# EasyEDA Pro project YanQi_Project.eprj, board PayloadBoard (continued)
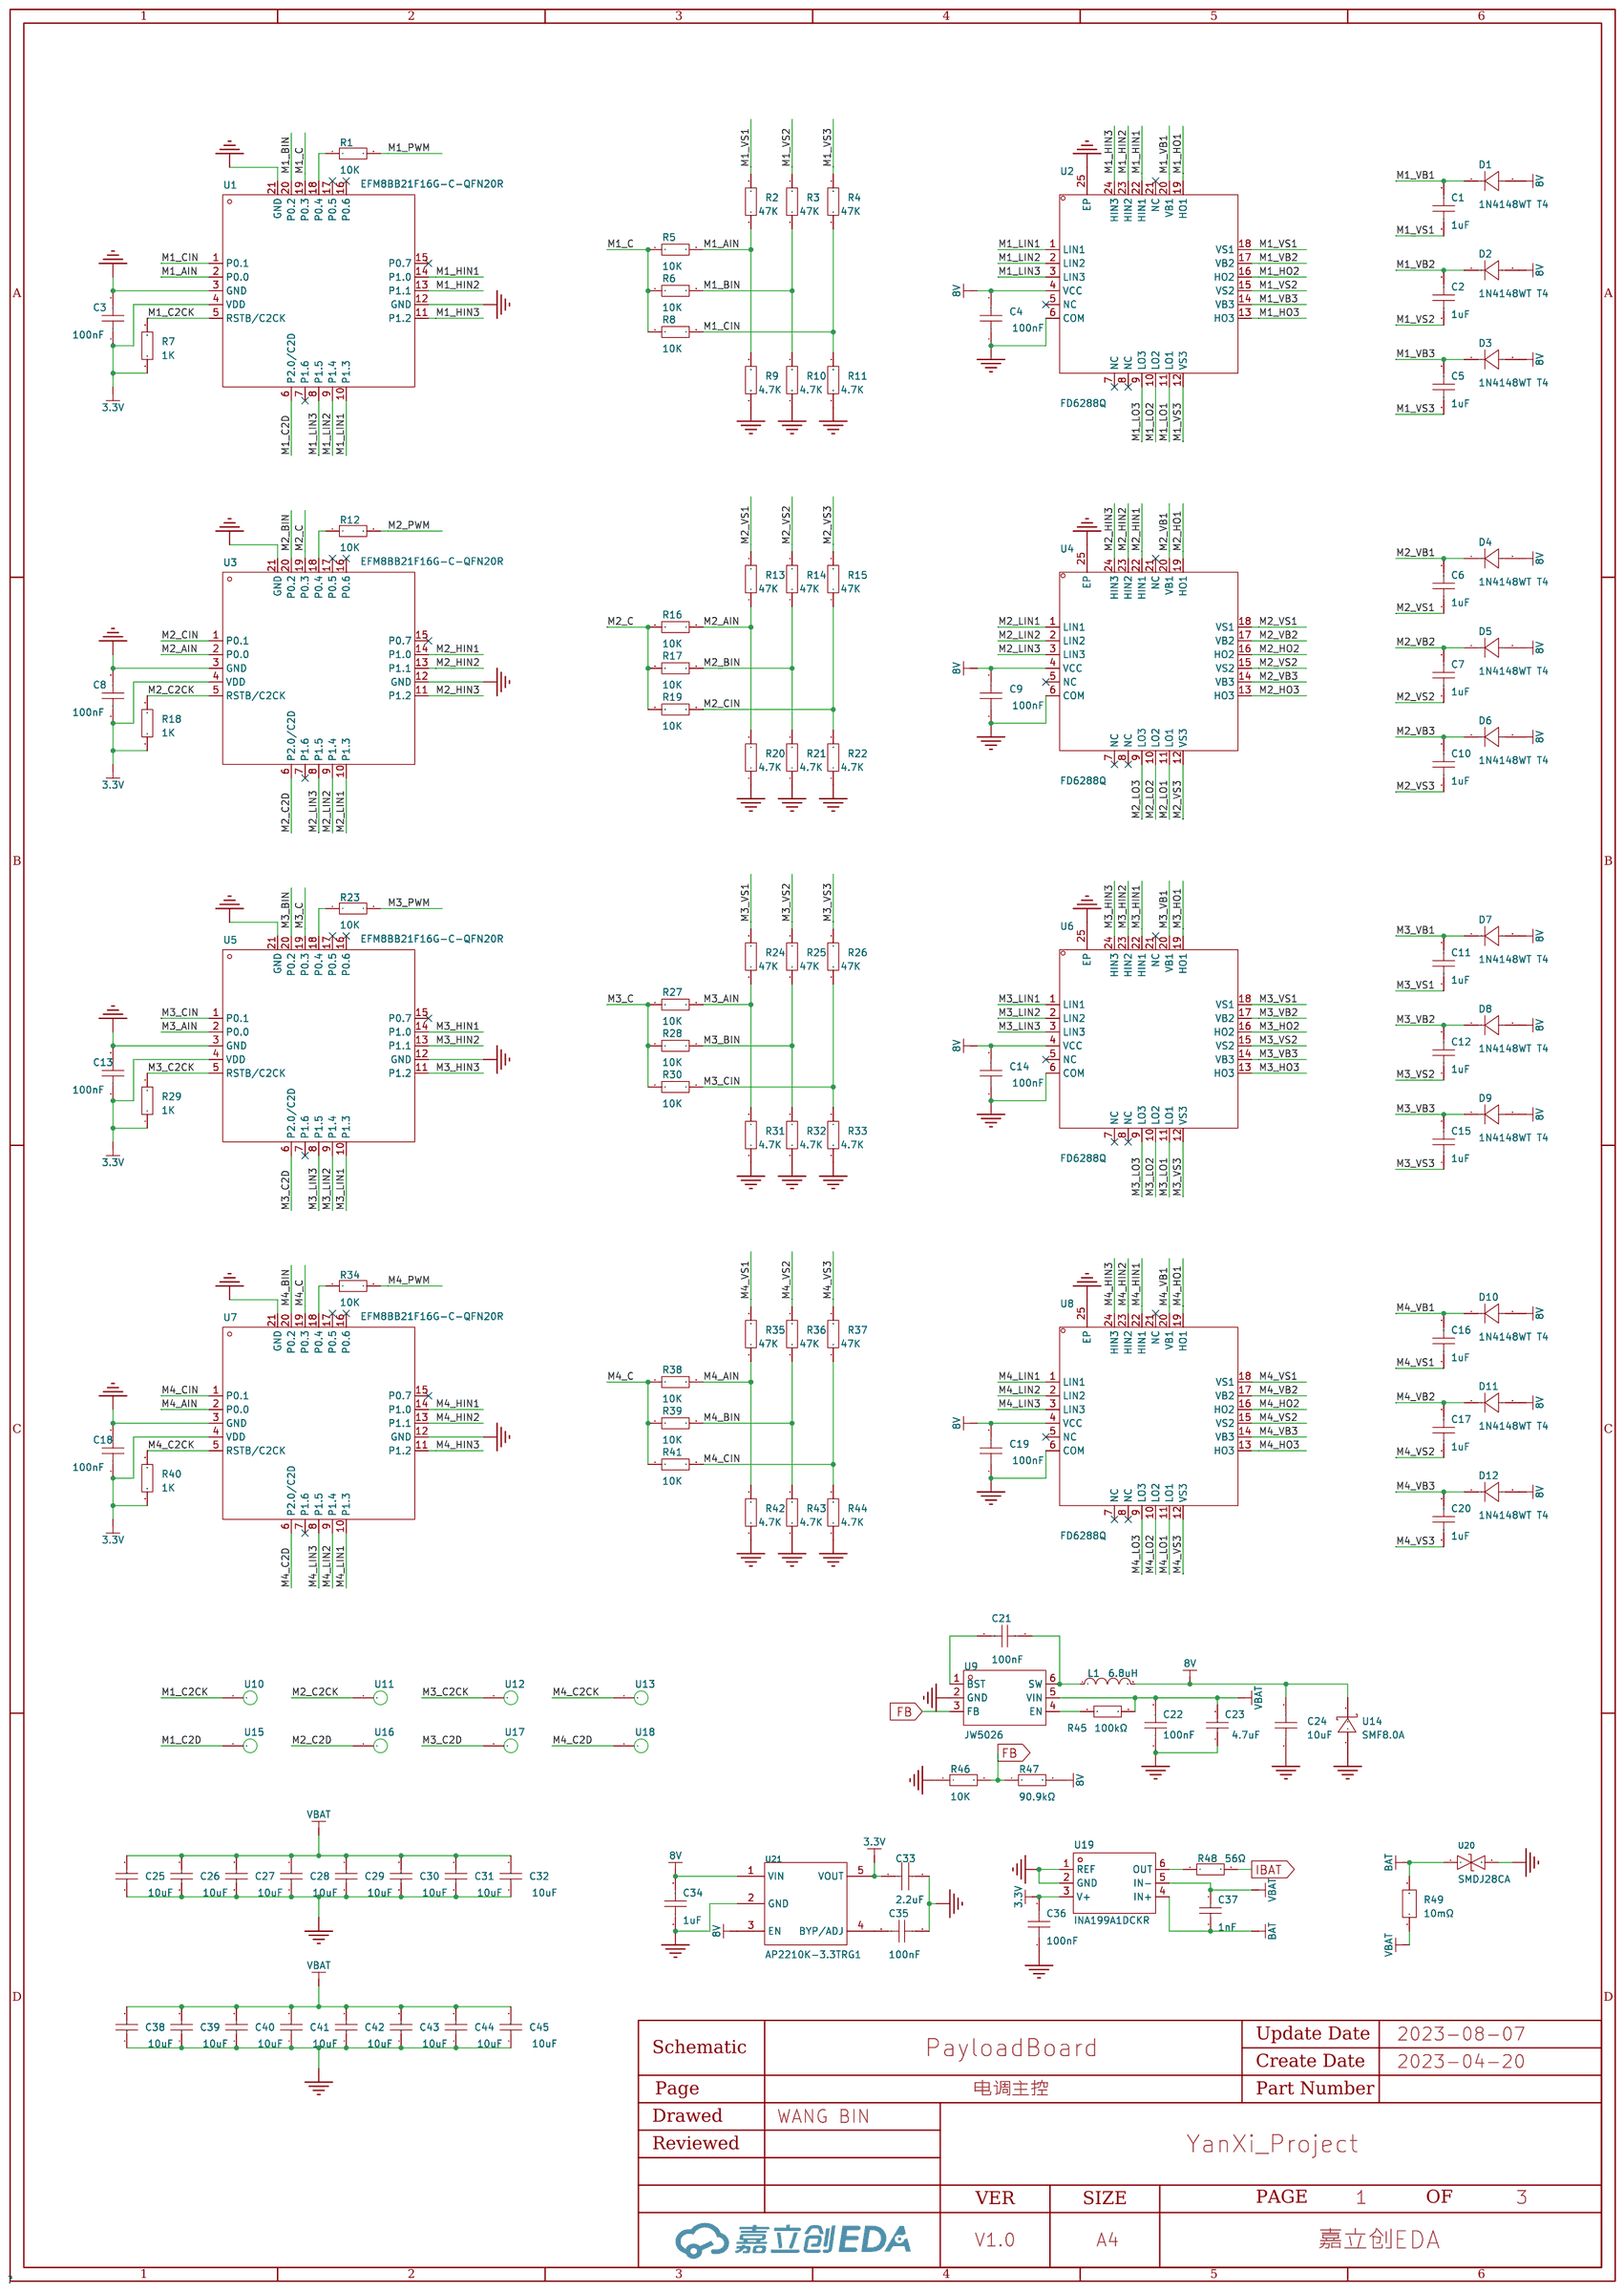
[diagram p0: 电调主控]
## Routing (per net, layer and track width the routed paths; a pad name or vN(x,y) marks a point on that pad's centre or on a via; arc(x,y) is an arc through that point) (continued)
GND:
  vias: v1(0.53,59) v1(1.03,59) v1(4.61,63) v1(4.8,75) v1(4.8,74.5) v1(4.8,74) v1(4.8,73.5) v1(4.8,73) v1(4.75,55.37) v1(4.75,54.87) v1(4.75,54.37) v1(4.8,45) v1(4.8,44.5) v1(4.8,44) v1(4.8,43.5) v1(4.8,43) v1(5.11,63.5) v1(5.11,63) v1(5.11,62.5) v1(5.3,75) v1(5.3,74.5) v1(5.3,74) v1(5.3,73.5) v1(5.3,73) v1(5.25,55.37) v1(5.25,54.87) v1(5.25,54.37) v1(5.3,45) v1(5.3,44.5) v1(5.3,44) v1(5.3,43.5) v1(5.3,43) v1(5.61,63) v1(6.7,76.3) v1(6.7,75.8) v1(6.7,42.2) v1(6.7,41.7) v1(6.84,66.3) v1(7.2,76.3) v1(7.2,75.8) v1(7.2,42.2) v1(7.2,41.7) v1(7.7,76.3) v1(7.7,75.8) v1(7.7,42.2) v1(7.7,41.7) v1(8.2,76.3) v1(8.2,75.8) v1(8.2,42.2) v1(8.2,41.7) v1(8.7,76.3) v1(8.7,75.8) v1(8.7,42.2) v1(8.7,41.7) v1(8.88,51.7) v1(10.12,55) v1(10.48,62.63) v1(10.62,55.5) v1(10.62,55) v1(10.62,54.5) v1(10.7,76.3) v1(10.7,75.8) v1(10.7,42.2) v1(10.7,41.7) v1(10.98,62.63) v1(11.12,55) v1(11.2,76.3) v1(11.2,75.8) v1(11.2,42.2) v1(11.2,41.7) v1(11.7,76.3) v1(11.7,75.8) v1(11.7,42.2) v1(11.7,41.7) v1(12.2,76.3) v1(12.2,75.8) v1(12.2,42.2) v1(12.2,41.7) v1(12.7,76.3) v1(12.7,75.8) v1(12.7,42.2) v1(12.7,41.7) v1(12.9,35.2) v1(12.9,34.7) v1(13.1,83.1) v1(13.1,82.6) v1(13.4,35.2) v1(13.4,34.7) v1(13.6,83.1) v1(13.6,82.6) v1(14.6,59.1) v1(15.2,35.4) v1(18.2,35.41) v1(24.2,35.41) v1(27.2,35.41) v1(30.2,35.41) v1(33.2,35.41) v1(36.2,35.4) v1(36.6,88.8) v1(40.7,43.6) v1(40.7,43.1) v1(41.2,43.6) v1(41.2,43.1) v1(47.8,88.8) v1(62.2,35.41) v1(62.7,42.4) v1(62.7,41.9) v1(63.2,42.4) v1(63.2,41.9) v1(64.4,78.4) v1(64.4,77.9) v1(64.9,78.4) v1(64.9,77.9) v1(65.2,35.4) v1(65.4,78.4) v1(65.4,77.9) v1(65.9,78.4) v1(65.9,77.9) v1(66.4,78.4) v1(66.4,77.9) v1(66.9,78.4) v1(66.9,77.9) v1(67.4,78.4) v1(67.4,77.9) v1(67.9,78.4) v1(67.9,77.9) v1(68.2,35.41) v1(68.4,78.4) v1(68.4,77.9) v1(68.9,78.4) v1(68.9,77.9) v1(71.2,35.4) v1(72.9,81.64) v1(74.2,35.41) v1(77.2,35.41) v1(80.2,35.4) v1(83.2,35.4) v1(83.79,62.87) v1(83.79,58.9) v1(84.8,83.2) v1(84.8,82.7) v1(84.8,35.4) v1(84.8,34.9) v1(85.3,83.2) v1(85.3,82.7) v1(85.3,35.4) v1(85.3,34.9) v1(85.7,76.3) v1(85.7,75.8) v1(85.7,42.2) v1(85.7,41.7) v1(86.2,76.3) v1(86.2,75.8) v1(86.2,42.2) v1(86.2,41.7) v1(86.7,76.3) v1(86.7,75.8) v1(86.7,42.2) v1(86.7,41.7) v1(87.2,76.3) v1(87.2,75.8) v1(87.2,42.2) v1(87.2,41.7) v1(87.28,63) v1(87.42,55.37) v1(87.42,54.87) v1(87.42,54.37) v1(87.7,76.3) v1(87.7,75.8) v1(87.7,42.2) v1(87.7,41.7) v1(87.78,63.5) v1(87.78,63) v1(87.78,62.5) v1(87.92,55.37) v1(87.92,54.87) v1(88.28,63) v1(89.52,66.3) v1(89.7,76.3) v1(89.7,75.8) v1(89.7,42.2) v1(89.7,41.7) v1(90.2,76.3) v1(90.2,75.8) v1(90.2,42.2) v1(90.2,41.7) v1(90.7,76.3) v1(90.7,75.8) v1(90.7,42.2) v1(90.7,41.7) v1(91.2,76.3) v1(91.2,75.8) v1(91.2,42.2) v1(91.2,41.7) v1(91.55,51.7) v1(91.7,76.3) v1(91.7,75.8) v1(91.7,42.2) v1(91.7,41.7) v1(92.79,55) v1(93.1,75) v1(93.1,74.5) v1(93.1,74) v1(93.1,73.5) v1(93.1,73) v1(93.15,63.13) v1(93.15,62.63) v1(93.1,45) v1(93.1,44.5) v1(93.1,44) v1(93.1,43.5) v1(93.1,43) v1(93.29,55.5) v1(93.29,55) v1(93.29,54.5) v1(93.6,75) v1(93.6,74.5) v1(93.6,74) v1(93.6,73.5) v1(93.6,73) v1(93.65,63.13) v1(93.65,62.63) v1(93.6,45) v1(93.6,44.5) v1(93.6,44) v1(93.6,43.5) v1(93.6,43) v1(93.79,55) v1(97.3,59.01) v1(97.8,59.01)
VBAT: length 237.9
  Top Layer w0.254: U19.5 31.5,81.5 30.9,80.9 C37.2 30.74,78.6 30.24,78.1 17.9,78.1 R49.1
  Top Layer w0.5: 75.7,81.44 75.55,81.44 74.9,80.8 U9.5 73.4,80.8 72.9,80.3 72.9,78.7 C23.2 72.43,77.77 v1(73.8,77.77) ; 17.5,50.6 17.5,53.5 U28.1
  Top Layer w2: v1(82.2,69.7) 82.2,38.59 ; 82.2,38.59 C44.2 C43.2 C42.2 C41.2 C40.2 C39.2 C38.2 62.19,38.6 60.9,38.6 58.9,36.6 58.9,32.6 56,29.7 42.4,29.7 39.5,32.6 39.5,36.59 37.5,38.59 C32.2 C31.2 C30.2 C29.2 C28.2 C27.2 C26.2 16.2,38.59 ; 82.2,38.59 C45.2 ; 16.2,38.59 C25.2 ; 16.2,38.59 16.2,50.2 19,50.2 v1(19.2,50.4) v1(19.2,50.9) v1(19.2,51.4) ; 16.2,77.9 16.2,67.8 19,67.8 v1(19.2,67.6) v1(19.2,67.1) v1(19.2,66.6)
  Inner1 w0.5: v1(73.8,77.77) 81.73,77.77 82.2,77.3 v1(82.2,69.7)
  Inner1 w2: v1(19.2,67.6) v1(19.2,67.1) v1(19.2,66.6) v1(19.2,66.1) v1(19.2,51.9) v1(19.2,51.4) v1(19.2,50.9) v1(19.2,50.4)
  Inner2 w2: v1(19.2,67.6) v1(19.2,67.1) v1(19.2,66.6) v1(19.2,66.1) v1(19.2,51.9) v1(19.2,51.4) v1(19.2,50.9) v1(19.2,50.4)
  Bottom Layer w2: v1(19.2,50.4) v1(19.2,50.9) v1(19.2,51.4) v1(19.2,51.9) v1(19.2,66.1) v1(19.2,66.6) v1(19.2,67.1) v1(19.2,67.6)
  vias: v1(18.7,68.1) v1(18.7,67.6) v1(18.7,67.1) v1(18.7,66.6) v1(18.7,66.1) v1(18.7,51.9) v1(18.7,51.4) v1(18.7,50.9) v1(18.7,50.4) v1(18.7,49.9) v1(19.2,68.1) v1(19.2,49.9) v1(19.7,68.1) v1(19.7,67.6) v1(19.7,67.1) v1(19.7,66.6) v1(19.7,66.1) v1(19.7,51.9) v1(19.7,51.4) v1(19.7,50.9) v1(19.7,50.4) v1(19.7,49.9)
BAT: length 1.3
  Top Layer w0.254: C37.1 30.91,82.15 U19.4
  vias: v1(21.82,81.53) v1(21.82,81.03) v1(22.32,81.53) v1(22.32,81.03) v1(22.82,81.53) v1(22.82,81.03) v1(23.32,81.53) v1(23.32,81.03) v1(23.82,81.53) v1(23.82,81.03)
BUZ-: length 43.7
  Top Layer w0.254: v1(60.2,88.6) 59,89.8 52,89.8 51.3,90.5 47.1,90.5 46.4,89.8 40.4,89.8 39.7,90.5 U26.3
  Inner2 w0.254: v1(60.2,88.6) 63.62,88.6 65.4,86.82 65.4,83.8 65.9,83.3 70.9,83.3 71.38,82.82 v1(71.38,82.58)
  Bottom Layer w0.254: BUZZER1.2 71.38,78.98 v1(71.38,82.58)
FB: length 2.7
  Top Layer w0.5: U9.3 71.53,79.83 70.87,79.83 70.37,80.33 70.1,80.33 70.1,81.37
IBAT: length 37
  Inner1 w0.254: v1(16.5,57.5) 17,58 17,64 15.47,65.53 15.47,76.07 17.4,78 31.83,78 v1(32.1,78.27)
M1_AIN: length 5
  Top Layer w0.254: R9.2 R5.2 ; R5.2 84.69,60.8 86.8,60.8 87.03,61.02 U1.2 ; R5.2 R2.1
M1_BIN: length 9.4
  Top Layer w0.254: v1(87.61,66.3) v1(86.57,66.3) ; v1(85.75,62.17) 85.83,62.25 U1.20
  Inner1 w0.254: v1(90.38,66.3) 90.38,66.08 90.1,65.8 88.27,65.8 87.76,66.3 v1(87.61,66.3) ; v1(85.75,62.17) 86.57,63 v1(86.57,66.3)
M1_C: length 13.2
  Top Layer w0.254: U1.19 85.47,62.75 v1(85.45,62.77)
  Inner1 w0.254: v1(83.79,60.84) 83.28,61.35 83.28,63.38 v1(83.79,63.89) 84.91,62.77 v1(85.45,62.77) 85.45,65.95 86.31,66.81 87.97,66.81 v1(88.48,66.3)
M1_C2CK: length 3.3
  Top Layer w0.254: U10.1 90.19,59.83 R7.2 88.97,60.27 88.53,60.72 U1.5
M1_C2D: length 3.8
  Top Layer w0.254: U15.1 90.76,60.52 89.37,60.52 89.03,60.87 U1.6
M1_CIN: length 4.6
  Top Layer w0.254: U1.1 85.52,61.62 85.22,61.92 85.22,62.28 84.65,62.85 R8.2 R4.1
M1_HIN1: length 9
  Top Layer w0.254: v1(87.1,65.7) 87.53,65.27 U1.14 ; v1(93.68,65.72) 93.62,65.66 U2.22
  Inner1 w0.254: v1(93.68,65.72) 93.36,65.4 87.4,65.4 v1(87.1,65.7)
M1_HIN2: length 6.5
  Top Layer w0.254: U2.23 93.12,65.54 92.93,65.73 92.33,65.73 91.76,65.15 88.2,65.15 88.03,64.98 U1.13
M1_HIN3: length 3.9
  Top Layer w0.254: U2.24 92.38,64.8 90.21,64.8 89.8,64.38 U1.11
M1_HO1: length 9.4
  Top Layer w0.254: U2.19 95.18,65.1 v1(95.95,65.1) ; v1(94.13,71.5) Q1.4
  Inner2 w0.254: v1(94.13,71.5) 94.13,71.06 94.59,70.6 95.6,70.6 95.95,70.25 v1(95.95,65.1)
M1_HO2: length 16.4
  Top Layer w0.254: v1(96.7,63.3) 96.62,63.38 U2.16 ; v1(89.13,71.5) Q2.4
  Inner2 w0.254: v1(89.13,71.5) 89.13,71.06 89.9,70.29 89.9,68.2 90.3,67.8 94.9,67.8 95.44,67.26 95.44,63.55 95.7,63.3 v1(96.7,63.3)
M1_HO3: length 23.4
  Top Layer w0.254: v1(96.5,61.2) 96.1,61.2 95.8,61.5 95.8,61.86 U2.13 ; v1(84.13,71.5) Q3.4
  Inner2 w0.254: v1(96.5,61.2) 95.98,61.2 95.09,62.1 95.09,67.11 94.75,67.44 85.16,67.44 84.8,67.8 84.8,70.39 84.12,71.06 v1(84.12,71.5)
M1_LIN1: length 3
  Top Layer w0.254: U2.1 90.3,64.38 89.68,63.75 U1.10
M1_LIN2: length 3
  Top Layer w0.254: U1.9 89.76,63.25 90.38,63.88 U2.2
M1_LIN3: length 3
  Top Layer w0.254: U2.3 90.45,63.38 89.82,62.75 U1.8
M1_LO1: length 9.8
  Top Layer w0.254: v1(94.7,60.5) 94.62,60.58 U2.11
  Inner1 w0.254: v1(94.7,60.5) 94.7,67.92 v1(94.13,68.5)
  Bottom Layer w0.254: v1(94.13,68.5) Q7.4
M1_LO2: length 14.2
  Top Layer w0.254: v1(94.04,60.51) 94.12,60.6 U2.10
  Inner1 w0.254: v1(89.13,68.5) 89,68.38 v1(89,66.9)
  Inner2 w0.254: v1(89,66.9) 89,61.9 89.4,61.5 93.7,61.5 94.04,61.17 v1(94.04,60.51)
  Bottom Layer w0.254: v1(89.13,68.5) Q8.4
M1_LO3: length 18.2
  Top Layer w0.254: v1(92.9,60.5) 93.3,60.5 93.62,60.82 U2.9
  Inner2 w0.254: v1(84.13,68.5) 84.1,68.47 84.1,67.7 84.95,66.85 84.95,60.75 85.2,60.5 v1(92.9,60.5)
  Bottom Layer w0.254: v1(84.13,68.5) Q9.4
M1_PWM: length 129.3
  Inner2 w0.254: v1(16.5,63.5) 15.83,62.83 15.83,40.97 17.05,39.76 35.25,39.76 41.56,33.45 41.56,30.85 41.81,30.6 56.19,30.6 56.84,31.25 56.84,38.26 57.54,38.96 79.26,38.96 v1(80.4,40.1)
  Bottom Layer w0.254: v1(80.4,40.1) 81.8,40.1 82.86,41.17 82.86,65 v1(83.79,65.92)
M1_VB1: length 5.1
  Top Layer w0.254: v1(93.68,66.4) 94.24,66.4 94.62,66.02 ; 94.62,66.02 U2.20 ; 94.62,66.02 94.9,66.3 D1.1
  Inner1 w0.254: v1(91.55,66.3) 93.58,66.3 v1(93.68,66.4)
M1_VB2: length 4
  Top Layer w0.254: U2.17 97.16,63.88 v1(97.29,63.75)
  Inner1 w0.254: v1(97.29,61.3) v1(97.29,63.75)
M1_VB3: length 7.7
  Top Layer w0.254: C5.2 92.95,59.66 93.4,59.2 v1(95.4,59.2) 95.39,59.2 D3.1 ; U2.14 96.24,62.38 96.5,62.11 v1(96.5,61.9)
  Inner1 w0.254: v1(96.5,61.9) 96.4,61.9 96,61.5 96,59.8 v1(95.4,59.2)
M1_VS1: length 33.5
  Top Layer w0.254: U2.18 96.48,64.38 v1(96.6,64.5) ; C1.1 v1(92.64,66.9)
  Inner1 w0.254: v1(83.79,61.86) 84.04,61.6 94,61.6 94.34,61.94 94.34,66.66 94,67 92.74,67 v1(92.64,66.9) 92.64,69.96 93.02,70.35 v1(94.13,70.35) 96.23,70.35 96.6,69.97 v1(96.6,64.5)
  Bottom Layer w0.254: v1(94.13,70.35) Q7.9
  vias: v1(94.9,75) v1(94.9,74.5) v1(94.9,74) v1(94.9,73.5) v1(94.9,73) v1(95.4,75) v1(95.4,74.5) v1(95.4,74) v1(95.4,73.5) v1(95.4,73) v1(95.9,75) v1(95.9,74.5) v1(95.9,74) v1(95.9,73.5) v1(95.9,73) v1(96.4,75) v1(96.4,74.5) v1(96.4,74) v1(96.4,73.5) v1(96.4,73) v1(96.9,75) v1(96.9,74.5) v1(96.9,74) v1(96.9,73.5) v1(96.9,73)
M1_VS2: length 28.4
  Top Layer w0.254: U2.15 96.29,62.88 96.52,62.65 v1(96.7,62.65) 96.96,62.39 C2.1 ; R3.2 85.61,66.4 v1(85.61,66.9)
  Inner1 w0.254: v1(96.7,62.65) 95.35,62.65 95.06,62.94 95.06,69.34 94.7,69.7 v1(94.13,69.7) ; v1(85.61,66.9) 85.61,67.2 86,67.6 88,67.6 88.3,67.9 88.3,70 88.65,70.35 v1(89.13,70.35)
  Inner2 w0.254: v1(89.13,70.35) 88.83,70.35 88.62,70.55 88.62,71.71 88.92,72 89.33,72 89.63,71.71 89.63,71.07 91,69.7 v1(94.13,69.7)
  Bottom Layer w0.254: v1(89.13,70.35) Q8.9
  vias: v1(89.9,75) v1(89.9,74.5) v1(89.9,74) v1(89.9,73.5) v1(89.9,73) v1(90.4,75) v1(90.4,74.5) v1(90.4,74) v1(90.4,73.5) v1(90.4,73) v1(90.9,75) v1(90.9,74.5) v1(90.9,74) v1(90.9,73.5) v1(90.9,73) v1(91.4,75) v1(91.4,74.5) v1(91.4,74) v1(91.4,73.5) v1(91.4,73) v1(91.9,75) v1(91.9,74.5) v1(91.9,74) v1(91.9,73.5) v1(91.9,73)
M1_VS3: length 26.4
  Top Layer w0.254: U2.12 95.12,61.03 95.4,60.75 v1(95.4,60.5)
  Inner1 w0.254: v1(84.13,70.35) 83.77,70.35 83.28,69.87 83.28,65.41 v1(83.79,64.91) ; v1(94.04,59.83) 94.98,59.83 95.4,60.24 v1(95.4,60.5)
  Inner2 w0.254: v1(83.79,64.91) 83.28,64.4 83.28,60.33 83.74,59.87 93.99,59.87 v1(94.04,59.83)
  Bottom Layer w0.254: v1(84.13,70.35) Q9.9
  vias: v1(84.9,75) v1(84.9,74.5) v1(84.9,74) v1(84.9,73.5) v1(84.9,73) v1(85.4,75) v1(85.4,74.5) v1(85.4,74) v1(85.4,73.5) v1(85.4,73) v1(85.9,75) v1(85.9,74.5) v1(85.9,74) v1(85.9,73.5) v1(85.9,73) v1(86.4,75) v1(86.4,74.5) v1(86.4,74) v1(86.4,73.5) v1(86.4,73) v1(86.9,75) v1(86.9,74.5) v1(86.9,74) v1(86.9,73.5) v1(86.9,73)
M2_AIN: length 5
  Top Layer w0.254: R16.2 R13.1 ; R16.2 13.71,57.2 11.6,57.2 11.37,56.98 U3.2 ; R16.2 R20.2
M2_BIN: length 9.5
  Top Layer w0.254: U3.20 12.58,55.75 v1(12.65,55.83) ; v1(10.79,51.7) v1(11.83,51.7)
  Inner1 w0.254: v1(8.02,51.7) 8.02,52.05 8.18,52.2 10.13,52.2 10.64,51.7 v1(10.79,51.7) ; v1(12.65,55.83) 11.83,55 v1(11.83,51.7)
M2_C: length 13.5
  Top Layer w0.254: v1(12.95,55.23) 12.93,55.25 U3.19
  Inner1 w0.254: v1(14.61,57.16) 15.12,56.66 15.12,54.61 v1(14.61,54.11) 13.49,55.23 v1(12.95,55.23) 12.95,51.97 11.98,51 10.62,51 v1(9.92,51.7)
M2_C2CK: length 3.3
  Top Layer w0.254: U11.1 8.21,58.17 R18.2 9.43,57.73 9.87,57.28 U3.5
M2_C2D: length 3.8
  Top Layer w0.254: U16.1 7.64,57.48 9.03,57.48 9.37,57.13 U3.6
M2_CIN: length 4.6
  Top Layer w0.254: R15.1 R19.2 R22.2 13.75,55.15 13.18,55.72 13.18,56.08 12.88,56.38 U3.1
M2_HIN1: length 9.1
  Top Layer w0.254: U4.22 4.78,52.34 v1(4.72,52.28) ; v1(11.3,52.3) 10.87,52.73 U3.14
  Inner1 w0.254: v1(4.72,52.28) 5.24,52.8 10.8,52.8 v1(11.3,52.3)
M2_HIN2: length 6.5
  Top Layer w0.254: U4.23 5.28,52.46 5.47,52.27 6.07,52.27 6.4,52.6 9.95,52.6 10.37,53.02 U3.13
M2_HIN3: length 3.9
  Top Layer w0.254: U4.24 5.91,53.1 8.85,53.1 U3.11
M2_HO1: length 9.4
  Top Layer w0.254: U4.19 3.22,52.9 v1(2.45,52.9) ; v1(4.28,46.5) 3.48,46.5
  Inner2 w0.254: v1(2.45,52.9) 2.45,47.75 2.8,47.4 3.73,47.4 4.28,46.86 v1(4.28,46.5)
M2_HO2: length 16.4
  Top Layer w0.254: v1(9.28,46.5) 8.48,46.5 ; v1(1.7,54.7) 1.78,54.62 U4.16
  Inner2 w0.254: v1(1.7,54.7) 2.7,54.7 2.96,54.45 2.96,50.54 3.4,50.1 8,50.1 8.5,49.6 8.5,47.71 9.28,46.94 v1(9.28,46.5)
M2_HO3: length 23.1
  Top Layer w0.254: v1(14.28,46.5) 13.48,46.5 ; v1(1.9,56.8) 2.3,56.8 2.6,56.5 2.6,56.14 U4.13
  Inner2 w0.254: v1(14.28,46.5) 14.28,46.86 13.6,47.53 13.6,49.8 12.84,50.56 3.73,50.56 3.5,50.79 3.5,55.73 2.43,56.8 v1(1.9,56.8)
M2_LIN1: length 3
  Top Layer w0.254: U4.1 8.1,53.62 8.72,54.25 U3.10
M2_LIN2: length 3
  Top Layer w0.254: U4.2 8.02,54.12 8.64,54.75 U3.9
M2_LIN3: length 3
  Top Layer w0.254: U3.8 8.58,55.25 7.95,54.62 U4.3
M2_LO1: length 10
  Top Layer w0.254: v1(3.7,57.5) 3.78,57.42 U4.11
  Inner1 w0.254: v1(4.28,49.5) 3.5,50.28 3.5,57.3 v1(3.7,57.5)
  Bottom Layer w0.254: v1(4.28,49.5) 3.48,49.5
M2_LO2: length 14.2
  Top Layer w0.254: v1(4.37,57.49) 4.28,57.4 U4.10
  Inner1 w0.254: v1(9.28,49.5) 9.4,49.62 v1(9.4,51.1)
  Inner2 w0.254: v1(9.4,51.1) 9.4,56.1 9,56.5 4.7,56.5 4.37,56.83 v1(4.37,57.49)
  Bottom Layer w0.254: v1(9.28,49.5) 8.48,49.5
M2_LO3: length 18.3
  Top Layer w0.254: v1(5.5,57.5) 5.1,57.5 4.78,57.18 U4.9
  Inner2 w0.254: v1(5.5,57.5) 13.4,57.5 13.9,57 13.9,50.7 14.3,50.3 14.3,49.53 v1(14.28,49.5)
  Bottom Layer w0.254: v1(14.28,49.5) 13.48,49.5
M2_PWM: length 12.7
  Top Layer w0.254: R12.2 15.85,52.08 v1(16.6,52.83)
  Bottom Layer w0.254: v1(16.5,62.5) 16.3,62.5 15.85,62.05 15.85,53.58 v1(16.6,52.83)
M2_VB1: length 5.1
  Top Layer w0.254: D4.1 3.5,51.7 3.78,51.98 ; 3.78,51.98 U4.20 ; 3.78,51.98 4.16,51.6 v1(4.72,51.6)
  Inner1 w0.254: v1(4.72,51.6) 4.82,51.7 v1(6.85,51.7)
M2_VB2: length 4
  Top Layer w0.254: U4.17 1.24,54.12 v1(1.12,54.25)
  Inner1 w0.254: v1(1.12,56.7) v1(1.12,54.25)
M2_VB3: length 7.7
  Top Layer w0.254: U4.14 2.16,55.62 1.9,55.89 v1(1.9,56.1) ; C10.2 5.45,58.34 5,58.8 v1(3,58.8) 3.01,58.8 D6.1
  Inner1 w0.254: v1(1.9,56.1) 2,56.1 2.4,56.5 2.4,58.2 v1(3,58.8)
M2_VS1: length 33.5
  Top Layer w0.254: C6.1 v1(5.76,51.1) ; v1(1.8,53.5) 1.92,53.62 U4.18
  Inner1 w0.254: v1(14.61,56.14) 14.36,56.4 4.4,56.4 4.06,56.06 4.06,51.34 4.4,51 5.66,51 v1(5.76,51.1) 5.76,48.04 5.38,47.65 v1(4.28,47.65) 2.17,47.65 1.8,48.03 v1(1.8,53.5)
  Bottom Layer w0.254: v1(4.28,47.65) Q19.9
  vias: v1(1.5,45) v1(1.5,44.5) v1(1.5,44) v1(1.5,43.5) v1(1.5,43) v1(2,45) v1(2,44.5) v1(2,44) v1(2,43.5) v1(2,43) v1(2.5,45) v1(2.5,44.5) v1(2.5,44) v1(2.5,43.5) v1(2.5,43) v1(3,45) v1(3,44.5) v1(3,44) v1(3,43.5) v1(3,43) v1(3.5,45) v1(3.5,44.5) v1(3.5,44) v1(3.5,43.5) v1(3.5,43)
M2_VS2: length 28.4
  Top Layer w0.254: v1(12.79,51.1) 12.79,51.6 R14.2 ; C7.1 1.44,55.61 v1(1.7,55.35) 1.89,55.35 2.11,55.12 U4.15
  Inner1 w0.254: v1(1.7,55.35) 2.7,55.35 2.96,55.1 2.96,49.04 3.7,48.3 v1(4.28,48.3) ; v1(12.79,51.1) 12.79,50.8 12.4,50.4 10.8,50.4 10.3,49.9 10.3,48.2 9.75,47.65 v1(9.28,47.65)
  Inner2 w0.254: v1(9.28,47.65) 9.63,47.65 9.93,47.36 9.93,46.23 9.51,45.81 8.99,45.81 8.6,46.2 8.6,46.82 7.12,48.3 v1(4.28,48.3)
  Bottom Layer w0.254: v1(9.28,47.65) Q20.9
  vias: v1(6.5,45) v1(6.5,44.5) v1(6.5,44) v1(6.5,43.5) v1(6.5,43) v1(7,45) v1(7,44.5) v1(7,44) v1(7,43.5) v1(7,43) v1(7.5,45) v1(7.5,44.5) v1(7.5,44) v1(7.5,43.5) v1(7.5,43) v1(8,45) v1(8,44.5) v1(8,44) v1(8,43.5) v1(8,43) v1(8.5,45) v1(8.5,44.5) v1(8.5,44) v1(8.5,43.5) v1(8.5,43)
M2_VS3: length 26.2
  Top Layer w0.254: U4.12 3.28,56.97 3,57.25 v1(3,57.5)
  Inner1 w0.254: v1(3,57.5) 3,57.76 3.42,58.17 v1(4.37,58.17) ; v1(14.28,47.65) 14.61,47.65 14.9,47.94 14.9,52.81 v1(14.61,53.09)
  Inner2 w0.254: v1(4.37,58.17) 4.41,58.13 14.66,58.13 15.12,57.67 15.12,53.6 v1(14.61,53.09)
  Bottom Layer w0.254: v1(14.28,47.65) Q21.9
  vias: v1(11.5,45) v1(11.5,44.5) v1(11.5,44) v1(11.5,43.5) v1(11.5,43) v1(12,45) v1(12,44.5) v1(12,44) v1(12,43.5) v1(12,43) v1(12.5,45) v1(12.5,44.5) v1(12.5,44) v1(12.5,43.5) v1(12.5,43) v1(13,45) v1(13,44.5) v1(13,44) v1(13,43.5) v1(13,43) v1(13.5,45) v1(13.5,44.5) v1(13.5,44) v1(13.5,43.5) v1(13.5,43)
M3_AIN: length 5
  Top Layer w0.254: U5.2 4.36,61.02 4.13,60.8 2.02,60.8 R27.2 ; R27.2 R24.1 ; R27.2 R31.2
M3_BIN: length 9.5
  Top Layer w0.254: U5.20 3.15,62.25 v1(3.08,62.17) ; v1(4.94,66.3) v1(3.9,66.3)
  Inner1 w0.254: v1(4.94,66.3) 5.09,66.3 5.6,65.8 7.5,65.8 7.71,66.01 v1(7.71,66.3) ; v1(3.08,62.17) 3.9,63 v1(3.9,66.3)
M3_C: length 13.2
  Top Layer w0.254: v1(2.78,62.77) 2.8,62.75 U5.19
  Inner1 w0.254: v1(1.12,60.84) 0.61,61.34 0.61,63.39 v1(1.12,63.89) 2.24,62.77 v1(2.78,62.77) 2.78,65.95 3.64,66.81 5.3,66.81 v1(5.81,66.3)
M3_C2CK: length 3.3
  Top Layer w0.254: U5.5 5.86,60.72 6.3,60.27 R29.2 7.52,59.83 U12.1
M3_C2D: length 3.8
  Top Layer w0.254: U17.1 8.09,60.52 6.7,60.52 6.36,60.87 U5.6
M3_CIN: length 4.6
  Top Layer w0.254: R26.1 R30.2 R33.2 1.98,62.85 2.55,62.28 2.55,61.92 2.85,61.62 U5.1
M3_HIN1: length 9
  Top Layer w0.254: U6.22 10.95,65.66 v1(11.01,65.72) ; U5.14 4.86,65.27 v1(4.43,65.7)
  Inner1 w0.254: v1(11.01,65.72) 10.69,65.4 4.73,65.4 v1(4.43,65.7)
M3_HIN2: length 6.5
  Top Layer w0.254: U5.13 5.36,64.98 5.53,65.15 9.08,65.15 9.66,65.73 10.26,65.73 10.45,65.54 U6.23
M3_HIN3: length 3.9
  Top Layer w0.254: U5.11 7.12,64.38 7.54,64.8 9.71,64.8 U6.24
M3_HO1: length 10.4
  Top Layer w0.254: v1(13.28,65.1) 12.51,65.1 U6.19 ; v1(10.72,71.5) Q4.4
  Inner2 w0.254: v1(13.28,65.1) 13.28,71.12 12.9,71.5 v1(10.72,71.5)
M3_HO2: length 17.4
  Top Layer w0.254: v1(5.72,71.5) Q5.4 ; v1(14.03,63.3) 13.95,63.38 U6.16
  Inner2 w0.254: v1(14.03,63.3) 13.03,63.3 12.77,63.55 12.77,67.26 12.23,67.8 7.63,67.8 7.23,68.2 7.23,71.17 6.9,71.5 v1(5.72,71.5)
M3_HO3: length 24.3
  Top Layer w0.254: v1(13.83,61.2) 13.43,61.2 13.13,61.5 13.13,61.86 U6.13 ; v1(0.72,71.5) Q6.4
  Inner2 w0.254: v1(0.72,71.5) 1.8,71.5 2.13,71.17 2.13,67.8 2.48,67.44 12.08,67.44 12.42,67.11 12.42,62.09 13.3,61.2 v1(13.83,61.2)
M3_LIN1: length 3
  Top Layer w0.254: U5.10 7.01,63.75 7.63,64.38 U6.1
M3_LIN2: length 3
  Top Layer w0.254: U5.9 7.09,63.25 7.71,63.88 U6.2
M3_LIN3: length 3
  Top Layer w0.254: U6.3 7.78,63.38 7.15,62.75 U5.8
M3_LO1: length 10.5
  Top Layer w0.254: v1(12.03,60.5) 11.95,60.58 U6.11
  Inner1 w0.254: v1(12.03,60.5) 12.03,67.92 11.45,68.5 v1(10.72,68.5)
  Bottom Layer w0.254: v1(10.72,68.5) Q10.4
M3_LO2: length 14.5
  Top Layer w0.254: U6.10 11.45,60.6 v1(11.36,60.51)
  Inner1 w0.254: v1(5.73,68.5) 6,68.5 6.33,68.17 v1(6.33,66.9)
  Inner2 w0.254: v1(11.36,60.51) 11.36,61.17 11.03,61.5 6.73,61.5 6.33,61.9 v1(6.33,66.9)
  Bottom Layer w0.254: v1(5.72,68.5) Q11.4
M3_LO3: length 19
  Top Layer w0.254: U6.9 10.95,60.82 10.63,60.5 v1(10.23,60.5)
  Inner2 w0.254: v1(10.23,60.5) 2.33,60.5 1.83,61 1.83,67.41 1.58,67.67 1.58,68.22 1.3,68.5 v1(0.73,68.5)
  Bottom Layer w0.254: v1(0.72,68.5) Q12.4
M3_PWM: length 27.7
  Top Layer w0.254: v1(1.3,66.9) 1.12,66.72 1.12,65.92
  Inner1 w0.254: v1(16.5,61.5) 15.9,61.5 15.12,62.28 15.12,70.28 14.5,70.9 5.52,70.9 4.86,70.24 4.86,68.23 4.59,67.96 3.19,67.96 2.13,66.9 v1(1.3,66.9)
M3_VB1: length 5.1
  Top Layer w0.254: 11.95,66.02 U6.20 ; 11.95,66.02 11.57,66.4 v1(11.01,66.4) ; 11.95,66.02 12.23,66.3 D7.1
  Inner1 w0.254: v1(8.88,66.3) 10.91,66.3 v1(11.01,66.4)
M3_VB2: length 4
  Top Layer w0.254: v1(14.61,63.75) 14.49,63.88 U6.17
  Inner1 w0.254: v1(14.61,61.3) v1(14.61,63.75)
M3_VB3: length 7.7
  Top Layer w0.254: D9.1 12.72,59.2 v1(12.73,59.2) 10.73,59.2 10.27,59.66 C15.2 ; U6.14 13.57,62.38 13.83,62.11 v1(13.83,61.9)
  Inner1 w0.254: v1(13.83,61.9) 13.73,61.9 13.33,61.5 13.33,59.8 v1(12.73,59.2)
M3_VS1: length 33.5
  Top Layer w0.254: U6.18 13.81,64.38 v1(13.93,64.5) ; C11.1 v1(9.97,66.9)
  Inner1 w0.254: v1(13.93,64.5) 13.93,69.97 13.55,70.35 v1(10.73,70.35) 10.35,70.35 9.97,69.96 v1(9.97,66.9) 10.06,67 11.33,67 11.67,66.66 11.67,61.94 11.33,61.6 1.37,61.6 v1(1.12,61.86)
  Bottom Layer w0.254: v1(10.73,70.35) Q10.9
  vias: v1(11.5,75) v1(11.5,74.5) v1(11.5,74) v1(11.5,73.5) v1(11.5,73) v1(12,75) v1(12,74.5) v1(12,74) v1(12,73.5) v1(12,73) v1(12.5,75) v1(12.5,74.5) v1(12.5,74) v1(12.5,73.5) v1(12.5,73) v1(13,75) v1(13,74.5) v1(13,74) v1(13,73.5) v1(13,73) v1(13.5,75) v1(13.5,74.5) v1(13.5,74) v1(13.5,73.5) v1(13.5,73)
M3_VS2: length 28.8
  Top Layer w0.254: C12.1 14.29,62.39 v1(14.03,62.65) 13.84,62.65 13.62,62.88 U6.15 ; R25.2 2.94,66.4 v1(2.94,66.9)
  Inner1 w0.254: v1(2.94,66.9) 2.94,67.2 3.33,67.6 4.9,67.6 5.22,67.92 5.22,70.1 5.47,70.35 v1(5.73,70.35) ; v1(14.03,62.65) 12.68,62.65 12.39,62.94 12.39,69.34 12.03,69.7 v1(10.73,69.7)
  Inner2 w0.254: v1(5.73,70.35) 5.53,70.35 5.22,70.65 5.22,71.71 5.52,72 6.9,72 7.58,71.32 7.58,70.05 7.94,69.7 v1(10.73,69.7)
  Bottom Layer w0.254: v1(5.73,70.35) Q11.9
  vias: v1(6.5,75) v1(6.5,74.5) v1(6.5,74) v1(6.5,73.5) v1(6.5,73) v1(7,75) v1(7,74.5) v1(7,74) v1(7,73.5) v1(7,73) v1(7.5,75) v1(7.5,74.5) v1(7.5,74) v1(7.5,73.5) v1(7.5,73) v1(8,75) v1(8,74.5) v1(8,74) v1(8,73.5) v1(8,73) v1(8.5,75) v1(8.5,74.5) v1(8.5,74) v1(8.5,73.5) v1(8.5,73)
M3_VS3: length 26.4
  Top Layer w0.254: v1(12.73,60.5) 12.73,60.75 12.45,61.03 U6.12
  Inner1 w0.254: v1(0.73,70.35) 1.03,70.35 1.3,70.08 1.3,68.36 0.76,67.83 0.76,65.26 v1(1.12,64.91) ; v1(11.36,59.83) 12.31,59.83 12.73,60.24 v1(12.73,60.5)
  Inner2 w0.254: v1(1.12,64.91) 0.61,64.4 0.61,60.33 1.06,59.87 11.32,59.87 v1(11.36,59.83)
  Bottom Layer w0.254: v1(0.73,70.35) Q12.9
  vias: v1(1.5,75) v1(1.5,74.5) v1(1.5,74) v1(1.5,73.5) v1(1.5,73) v1(2,75) v1(2,74.5) v1(2,74) v1(2,73.5) v1(2,73) v1(2.5,75) v1(2.5,74.5) v1(2.5,74) v1(2.5,73.5) v1(2.5,73) v1(3,75) v1(3,74.5) v1(3,74) v1(3,73.5) v1(3,73) v1(3.5,75) v1(3.5,74.5) v1(3.5,74) v1(3.5,73.5) v1(3.5,73)
M4_AIN: length 5
  Top Layer w0.254: R38.2 96.38,57.2 94.27,57.2 94.04,56.98 U7.2 ; R38.2 R35.1 ; R38.2 R42.2
M4_BIN: length 9.5
  Top Layer w0.254: v1(93.46,51.7) v1(94.5,51.7) ; v1(95.32,55.83) 95.25,55.75 U7.20
  Inner1 w0.254: v1(95.32,55.83) 94.5,55 v1(94.5,51.7) ; v1(93.46,51.7) 93.31,51.7 92.8,52.2 90.83,52.2 90.69,52.06 v1(90.69,51.7)
M4_C: length 13.2
  Top Layer w0.254: v1(95.62,55.23) 95.6,55.25 U7.19
  Inner1 w0.254: v1(97.29,57.16) 97.79,56.66 97.79,54.61 v1(97.29,54.11) 96.16,55.23 v1(95.62,55.23) 95.62,52.05 94.77,51.19 93.1,51.19 v1(92.59,51.7)
M4_C2CK: length 3.3
  Top Layer w0.254: U7.5 92.54,57.28 92.1,57.73 R40.2 90.88,58.17 U13.1
M4_C2D: length 3.8
  Top Layer w0.254: U7.6 92.04,57.13 91.7,57.48 90.31,57.48 U18.1
M4_CIN: length 4.6
  Top Layer w0.254: R37.1 R41.2 96.42,55.15 95.85,55.72 95.85,56.08 95.55,56.38 U7.1
M4_HIN1: length 9
  Top Layer w0.254: U8.22 87.45,52.34 v1(87.39,52.28) ; U7.14 93.54,52.73 v1(93.97,52.3)
  Inner1 w0.254: v1(87.39,52.28) 87.71,52.6 93.67,52.6 v1(93.97,52.3)
M4_HIN2: length 6.5
  Top Layer w0.254: U8.23 87.95,52.46 88.14,52.27 88.74,52.27 89.32,52.85 92.87,52.85 93.04,53.02 U7.13
M4_HIN3: length 3.9
  Top Layer w0.254: U8.24 88.69,53.2 90.86,53.2 91.27,53.62 U7.11
M4_HO1: length 10.4
  Top Layer w0.254: U8.19 85.89,52.9 v1(85.12,52.9) ; v1(87.68,46.5) 86.88,46.5
  Inner2 w0.254: v1(85.12,52.9) 85.12,46.88 85.5,46.5 v1(87.68,46.5)
M4_HO2: length 17.4
  Top Layer w0.254: v1(84.37,54.7) 84.45,54.62 U8.16 ; v1(92.68,46.5) 91.88,46.5
  Inner2 w0.254: v1(92.68,46.5) 91.5,46.5 91.17,46.83 91.17,49.8 90.77,50.2 86.17,50.2 85.63,50.74 85.63,54.45 85.37,54.7 v1(84.37,54.7)
M4_HO3: length 24.3
  Top Layer w0.254: U8.13 85.27,56.14 85.27,56.5 84.97,56.8 v1(84.57,56.8) ; v1(97.68,46.5) 96.88,46.5
  Inner2 w0.254: v1(97.68,46.5) 96.6,46.5 96.27,46.83 96.27,50.2 95.92,50.56 86.32,50.56 85.98,50.89 85.98,55.91 85.09,56.8 v1(84.57,56.8)
M4_LIN1: length 3
  Top Layer w0.254: U7.10 91.39,54.25 90.77,53.62 U8.1
M4_LIN2: length 3
  Top Layer w0.254: U8.2 90.69,54.12 91.31,54.75 U7.9
M4_LIN3: length 3
  Top Layer w0.254: U8.3 90.62,54.62 91.25,55.25 U7.8
M4_LO1: length 10.5
  Top Layer w0.254: U8.11 86.45,57.42 v1(86.37,57.5)
  Inner1 w0.254: v1(86.37,57.5) 86.37,50.08 86.95,49.5 v1(87.68,49.5)
  Bottom Layer w0.254: v1(87.68,49.5) 86.88,49.5
M4_LO2: length 14.5
  Top Layer w0.254: U8.10 86.95,57.4 v1(87.04,57.49)
  Inner1 w0.254: v1(92.07,51.1) 92.07,49.83 92.4,49.5 v1(92.67,49.5)
  Inner2 w0.254: v1(92.07,51.1) 92.07,56.1 91.67,56.5 87.37,56.5 87.04,56.83 v1(87.04,57.49)
  Bottom Layer w0.254: v1(92.68,49.5) 91.88,49.5
M4_LO3: length 19
  Top Layer w0.254: U8.9 87.45,57.18 87.77,57.5 v1(88.17,57.5)
  Inner2 w0.254: v1(97.67,49.5) 97.1,49.5 96.83,49.78 96.83,50.33 96.57,50.59 96.57,57 96.07,57.5 v1(88.17,57.5)
  Bottom Layer w0.254: v1(97.68,49.5) 96.88,49.5
M4_PWM: length 128
  Top Layer w0.254: v1(97.1,51.1) 97.29,51.28 R34.2
  Inner1 w0.254: v1(16.5,60.5) 15.83,59.83 15.83,40.97 17.75,39.06 36.05,39.06 41.6,33.5 41.6,33.49 41.66,33.45 41.66,30.85 41.91,30.6 56.19,30.6 56.84,31.25 56.84,38.84 v1(57.7,39.7) ; v1(57.7,37.9) 58.04,38.24 80.95,38.24 83.28,40.58 83.28,46.38 84,47.1 93,47.1 93.54,47.64 93.54,49.64 93.94,50.04 96.04,50.04 v1(97.1,51.1)
  Bottom Layer w0.254: v1(57.7,39.7) v1(57.7,37.9)
M4_VB1: length 5.1
  Top Layer w0.254: D10.1 86.17,51.7 86.45,51.98 ; v1(87.39,51.6) 86.83,51.6 86.45,51.98 ; 86.45,51.98 U8.20
  Inner1 w0.254: v1(89.52,51.7) 87.49,51.7 v1(87.39,51.6)
M4_VB2: length 4
  Top Layer w0.254: U8.17 83.91,54.12 v1(83.79,54.25)
  Inner1 w0.254: v1(83.79,56.7) v1(83.79,54.25)
M4_VB3: length 7.7
  Top Layer w0.254: C20.2 88.13,58.34 87.67,58.8 v1(85.67,58.8) 85.68,58.8 D12.1 ; U8.14 84.83,55.62 84.57,55.89 v1(84.57,56.1)
  Inner1 w0.254: v1(84.57,56.1) 84.67,56.1 85.08,56.5 85.08,58.2 v1(85.67,58.8)
M4_VS1: length 33.5
  Top Layer w0.254: U8.18 84.59,53.62 v1(84.47,53.5) ; C16.1 v1(88.43,51.1)
  Inner1 w0.254: v1(97.29,56.14) 97.03,56.4 87.07,56.4 86.73,56.06 86.73,51.34 87.07,51 88.33,51 v1(88.43,51.1) 88.43,48.04 88.05,47.65 v1(87.67,47.65) 84.85,47.65 84.47,48.03 v1(84.47,53.5)
  Bottom Layer w0.254: v1(87.67,47.65) Q22.9
  vias: v1(84.9,45) v1(84.9,44.5) v1(84.9,44) v1(84.9,43.5) v1(84.9,43) v1(85.4,45) v1(85.4,44.5) v1(85.4,44) v1(85.4,43.5) v1(85.4,43) v1(85.9,45) v1(85.9,44.5) v1(85.9,44) v1(85.9,43.5) v1(85.9,43) v1(86.4,45) v1(86.4,44.5) v1(86.4,44) v1(86.4,43.5) v1(86.4,43) v1(86.9,45) v1(86.9,44.5) v1(86.9,44) v1(86.9,43.5) v1(86.9,43)
M4_VS2: length 28.8
  Top Layer w0.254: U8.15 84.78,55.12 84.56,55.35 v1(84.37,55.35) 84.11,55.61 83.79,55.61 ; v1(95.46,51.1) 95.46,51.6 R36.2
  Inner1 w0.254: v1(87.67,48.3) 86.37,48.3 86.02,48.66 86.02,55.06 85.72,55.35 v1(84.37,55.35) ; v1(95.46,51.1) 95.46,50.8 95.07,50.4 93.5,50.4 93.18,50.08 93.18,47.9 92.93,47.65 v1(92.67,47.65)
  Inner2 w0.254: v1(92.67,47.65) 92.88,47.65 93.18,47.35 93.18,46.29 92.88,46 91.5,46 90.82,46.68 90.82,47.95 90.46,48.3 v1(87.67,48.3)
  Bottom Layer w0.254: v1(92.67,47.65) Q23.9
  vias: v1(89.9,45) v1(89.9,44.5) v1(89.9,44) v1(89.9,43.5) v1(89.9,43) v1(90.4,45) v1(90.4,44.5) v1(90.4,44) v1(90.4,43.5) v1(90.4,43) v1(90.9,45) v1(90.9,44.5) v1(90.9,44) v1(90.9,43.5) v1(90.9,43) v1(91.4,45) v1(91.4,44.5) v1(91.4,44) v1(91.4,43.5) v1(91.4,43) v1(91.9,45) v1(91.9,44.5) v1(91.9,44) v1(91.9,43.5) v1(91.9,43)
M4_VS3: length 26.4
  Top Layer w0.254: U8.12 85.95,56.97 85.67,57.25 v1(85.67,57.5)
  Inner1 w0.254: v1(97.67,47.65) 97.38,47.65 97.1,47.92 97.1,49.64 97.64,50.17 97.64,52.74 v1(97.29,53.09) ; v1(85.67,57.5) 85.67,57.76 86.09,58.17 v1(87.04,58.17)
  Inner2 w0.254: v1(87.04,58.17) 87.08,58.13 97.33,58.13 97.79,57.67 97.79,53.6 v1(97.29,53.09)
  Bottom Layer w0.254: v1(97.67,47.65) Q24.9
  vias: v1(94.9,45) v1(94.9,44.5) v1(94.9,44) v1(94.9,43.5) v1(94.9,43) v1(95.4,45) v1(95.4,44.5) v1(95.4,44) v1(95.4,43.5) v1(95.4,43) v1(95.9,45) v1(95.9,44.5) v1(95.9,44) v1(95.9,43.5) v1(95.9,43) v1(96.4,45) v1(96.4,44.5) v1(96.4,44) v1(96.4,43.5) v1(96.4,43) v1(96.9,45) v1(96.9,44.5) v1(96.9,44) v1(96.9,43.5) v1(96.9,43)
RGB: length 91.4
  Top Layer w0.254: v1(41.71,93.49) 41.71,92.21 U26.5
  Inner1 w0.254: 41.7,91.9 42.2,91.4 62.9,91.4 64.2,90.1 64.2,83.9 64.8,83.3 v1(81.5,83.3) ; 41.7,91.9 41.06,91.26 35.25,91.26 34.2,90.2 34.2,83.2 v1(34.4,83) ; 41.7,91.9 41.7,93.48 v1(41.71,93.49)
  Bottom Layer w0.254: v1(34.4,83) 33.8,82.4 15.6,82.4 LED1.4 ; LED10.4 82.4,79.8 82.4,82.4 v1(81.5,83.3)
RX1: length 81.2
  Inner1 w0.254: v1(59.71,90.36) 62.44,90.36 63,89.8 63,88.31 62.6,87.91 v1(62.6,87.2)
  Bottom Layer w0.254: H2.3 51.4,26.3 55.6,26.3 56.47,27.17 56.47,32.73 55.8,33.4 55.8,44.3 56.4,44.9 60.7,44.9 63,47.2 63,86.51 62.6,86.91 v1(62.6,87.2) ; U36.2 59.71,92.19 v1(59.71,90.36)
RX3: length 88
  Inner2 w0.254: v1(45.71,90.9) 44.5,90.9 43.4,89.8 36.18,89.8 33.84,87.46 33.84,86.74 35.07,85.52 35.07,74.74 35.5,74.31 v1(35.5,73.6)
  Bottom Layer w0.254: v1(35.5,73.6) 35.5,72.8 35.14,72.45 35.14,46.75 37.35,44.54 41.85,44.54 42.24,44.15 42.24,24.36 42.8,23.8 44.09,23.8 H3.2 ; v1(45.71,90.9) 45.71,92.19 U35.2
RX5: length 43.3
  Inner1 w0.254: v1(41.71,90.9) 35.4,90.9 34.7,90.2 v1(34.7,87.1)
  Bottom Layer w0.254: H1.4 50.87,74.14 35.66,74.14 35.07,74.73 35.07,86.41 34.7,86.78 v1(34.7,87.1) ; v1(41.71,90.9) 41.71,92.19 U35.6
RX7: length 13.7
  Bottom Layer w0.254: U35.4 43.7,91.2 41.8,89.3 40.1,89.3 38.9,90.5 35.5,90.5 35.1,90.1 35.1,89.4 34.08,88.38 CN1.2
SCL2: length 91.4
  Top Layer w0.254: U26.10 v1(46.7,90.9) ; v1(56.4,25.3) 52.9,25.3 52.2,26 H2.2
  Inner2 w0.254: v1(57.7,40.7) 57.7,42.02 63,47.32 63,86.19 63.8,86.99 63.8,87.41 63.51,87.7 49.9,87.7 v1(46.7,90.9)
  Bottom Layer w0.254: v1(57.7,40.7) 58.2,40.2 58.2,33.86 57.2,32.86 57.2,26.1 v1(56.4,25.3)
SDA2: length 94.7
  Top Layer w0.254: H2.1 56,27.5 57,26.5 57,25.1 v1(56.4,24.5) ; U26.9 v1(45.7,93.5)
  Inner2 w0.254: v1(45.7,93.5) 47.3,91.9 47.3,90.8 50.04,88.06 63.66,88.06 64.16,87.56 64.16,86.84 63.36,86.04 63.36,47.17 58.5,42.31 v1(58.5,40.7)
  Bottom Layer w0.254: v1(58.5,40.7) 58.6,40.6 58.6,33.75 57.56,32.71 57.56,25.66 v1(56.4,24.5)
TX1: length 85.2
  Inner1 w0.254: v1(58.7,90.9) 62.7,90.9 63.55,90.05 63.55,88.12 63.3,87.86 v1(63.3,87.2)
  Bottom Layer w0.254: v1(58.7,90.9) U36.3 ; H2.4 49.76,25.94 55.75,25.94 56.83,27.02 56.83,32.88 56.16,33.55 56.16,44.15 56.55,44.54 60.74,44.54 60.75,44.55 60.85,44.54 63.36,47.05 63.36,87.14 v1(63.3,87.2)
TX3: length 89.5
  Inner2 w0.254: v1(44.7,90.3) 44.7,89.9 44.24,89.44 36.33,89.44 34.2,87.31 34.2,86.89 35.42,85.67 35.42,75.28 36.2,74.5 v1(36.2,73.6)
  Bottom Layer w0.254: v1(36.2,73.6) 36.2,73 35.5,72.3 35.5,46.9 37.5,44.9 42,44.9 42.6,44.3 42.6,24.5 42.9,24.2 46.23,24.2 H3.3 ; v1(44.7,90.3) U35.3
TX5: length 50.3
  Inner1 w0.254: v1(40.7,90.3) 35.7,90.3 35.4,90 v1(35.4,87.1)
  Bottom Layer w0.254: v1(40.7,90.3) U35.7 ; H1.3 52.27,70.2 54.1,70.2 55,71.1 55,73 53.5,74.5 35.9,74.5 35.42,74.98 35.42,87.08 v1(35.4,87.1)
TX7: length 12.4
  Bottom Layer w0.254: CN1.3 34.33,89.38 34.6,89.65 34.6,90.5 35.1,91 39.1,91 40.3,89.8 41.31,89.8 42.7,91.18 U35.5
